# EAGLE schematic Resistor_Resistor (EAGLE 8.3.0), part 11 of 43
## Parts (continued)
R14498  10K  RESISTOR_0201  [0201]
R14499  10K  RESISTOR_0201  [0201]
R14500  10K  RESISTOR_0201  [0201]
R14501  10K  RESISTOR_0201  [0201]
R14502  10K  RESISTOR_0201  [0201]
R14503  10K  RESISTOR_0201  [0201]
R14504  10K  RESISTOR_0201  [0201]
R14505  10K  RESISTOR_0201  [0201]
R14506  10K  RESISTOR_0201  [0201]
R14507  10K  RESISTOR_0201  [0201]
R14508  10K  RESISTOR_0201  [0201]
R14509  10K  RESISTOR_0201  [0201]
R14510  10K  RESISTOR_0201  [0201]
R14511  10K  RESISTOR_0201  [0201]
R14512  10K  RESISTOR_0201  [0201]
R14513  10K  RESISTOR_0201  [0201]
R14514  10K  RESISTOR_0201  [0201]
R14515  10K  RESISTOR_0201  [0201]
R14516  10K  RESISTOR_0201  [0201]
R14517  10K  RESISTOR_0201  [0201]
R14518  10K  RESISTOR_0201  [0201]
R14519  10K  RESISTOR_0201  [0201]
R14520  10K  RESISTOR_0201  [0201]
R14521  10K  RESISTOR_0201  [0201]
R14522  10K  RESISTOR_0201  [0201]
R14523  10K  RESISTOR_0201  [0201]
R14524  10K  RESISTOR_0201  [0201]
R14525  10K  RESISTOR_0201  [0201]
R14526  10K  RESISTOR_0201  [0201]
R14527  10K  RESISTOR_0201  [0201]
R14528  10K  RESISTOR_0201  [0201]
R14529  10K  RESISTOR_0201  [0201]
R14530  10K  RESISTOR_0201  [0201]
R14531  10K  RESISTOR_0201  [0201]
R14532  10K  RESISTOR_0201  [0201]
R14533  10K  RESISTOR_0201  [0201]
R14534  10K  RESISTOR_0201  [0201]
R14535  10K  RESISTOR_0201  [0201]
R14536  10K  RESISTOR_0201  [0201]
R14537  10K  RESISTOR_0201  [0201]
R14538  10K  RESISTOR_0201  [0201]
R14539  10K  RESISTOR_0201  [0201]
R14540  10K  RESISTOR_0201  [0201]
R14541  10K  RESISTOR_0201  [0201]
R14542  10K  RESISTOR_0201  [0201]
R14543  10K  RESISTOR_0201  [0201]
R14544  10K  RESISTOR_0201  [0201]
R14545  10K  RESISTOR_0201  [0201]
R14546  10K  RESISTOR_0201  [0201]
R14547  10K  RESISTOR_0201  [0201]
R14548  10K  RESISTOR_0201  [0201]
R14549  10K  RESISTOR_0201  [0201]
R14550  10K  RESISTOR_0201  [0201]
R14551  10K  RESISTOR_0201  [0201]
R14552  10K  RESISTOR_0201  [0201]
R14553  10K  RESISTOR_0201  [0201]
R14554  10K  RESISTOR_0201  [0201]
R14555  10K  RESISTOR_0201  [0201]
R14556  10K  RESISTOR_0201  [0201]
R14557  10K  RESISTOR_0201  [0201]
R14558  10K  RESISTOR_0201  [0201]
R14559  10K  RESISTOR_0201  [0201]
R14560  10K  RESISTOR_0201  [0201]
R14561  10K  RESISTOR_0201  [0201]
R14562  10K  RESISTOR_0201  [0201]
R14563  10K  RESISTOR_0201  [0201]
R14564  10K  RESISTOR_0201  [0201]
R14565  10K  RESISTOR_0201  [0201]
R14566  10K  RESISTOR_0201  [0201]
R14567  10K  RESISTOR_0201  [0201]
R14568  10K  RESISTOR_0201  [0201]
R14569  10K  RESISTOR_0201  [0201]
R14570  10K  RESISTOR_0201  [0201]
R14571  10K  RESISTOR_0201  [0201]
R14572  10K  RESISTOR_0201  [0201]
R14573  10K  RESISTOR_0201  [0201]
R14574  10K  RESISTOR_0201  [0201]
R14575  10K  RESISTOR_0201  [0201]
R14576  10K  RESISTOR_0201  [0201]
R14577  10K  RESISTOR_0201  [0201]
R14578  10K  RESISTOR_0201  [0201]
R14579  10K  RESISTOR_0201  [0201]
R14580  10K  RESISTOR_0201  [0201]
R14581  10K  RESISTOR_0201  [0201]
R14582  10K  RESISTOR_0201  [0201]
R14583  10K  RESISTOR_0201  [0201]
R14584  10K  RESISTOR_0201  [0201]
R14585  10K  RESISTOR_0201  [0201]
R14586  10K  RESISTOR_0201  [0201]
R14587  10K  RESISTOR_0201  [0201]
R14588  10K  RESISTOR_0201  [0201]
R14589  10K  RESISTOR_0201  [0201]
R14590  10K  RESISTOR_0201  [0201]
R14591  10K  RESISTOR_0201  [0201]
R14592  10K  RESISTOR_0201  [0201]
R14593  10K  RESISTOR_0201  [0201]
R14594  10K  RESISTOR_0201  [0201]
R14595  10K  RESISTOR_0201  [0201]
R14596  10K  RESISTOR_0201  [0201]
R14597  10K  RESISTOR_0201  [0201]
R14598  10K  RESISTOR_0201  [0201]
R14599  10K  RESISTOR_0201  [0201]
R14600  10K  RESISTOR_0201  [0201]
R14601  10K  RESISTOR_0201  [0201]
R14602  10K  RESISTOR_0201  [0201]
R14603  10K  RESISTOR_0201  [0201]
R14604  10K  RESISTOR_0201  [0201]
R14605  10K  RESISTOR_0201  [0201]
R14606  10K  RESISTOR_0201  [0201]
R14607  10K  RESISTOR_0201  [0201]
R14608  10K  RESISTOR_0201  [0201]
R14609  10K  RESISTOR_0201  [0201]
R14610  10K  RESISTOR_0201  [0201]
R14611  10K  RESISTOR_0201  [0201]
R14612  10K  RESISTOR_0201  [0201]
R14613  10K  RESISTOR_0201  [0201]
R14614  10K  RESISTOR_0201  [0201]
R14615  10K  RESISTOR_0201  [0201]
R14616  10K  RESISTOR_0201  [0201]
R14617  10K  RESISTOR_0201  [0201]
R14618  10K  RESISTOR_0201  [0201]
R14619  10K  RESISTOR_0201  [0201]
R14620  10K  RESISTOR_0201  [0201]
R14621  10K  RESISTOR_0201  [0201]
R14622  10K  RESISTOR_0201  [0201]
R14623  10K  RESISTOR_0201  [0201]
R14624  10K  RESISTOR_0201  [0201]
R14625  10K  RESISTOR_0201  [0201]
R14626  10K  RESISTOR_0201  [0201]
R14627  10K  RESISTOR_0201  [0201]
R14628  10K  RESISTOR_0201  [0201]
R14629  10K  RESISTOR_0201  [0201]
R14630  10K  RESISTOR_0201  [0201]
R14631  10K  RESISTOR_0201  [0201]
R14632  10K  RESISTOR_0201  [0201]
R14633  10K  RESISTOR_0201  [0201]
R14634  10K  RESISTOR_0201  [0201]
R14635  10K  RESISTOR_0201  [0201]
R14636  10K  RESISTOR_0201  [0201]
R14637  10K  RESISTOR_0201  [0201]
R14638  10K  RESISTOR_0201  [0201]
R14639  10K  RESISTOR_0201  [0201]
R14640  10K  RESISTOR_0201  [0201]
R14641  10K  RESISTOR_0201  [0201]
R14642  10K  RESISTOR_0201  [0201]
R14643  10K  RESISTOR_0201  [0201]
R14644  10K  RESISTOR_0201  [0201]
R14645  10K  RESISTOR_0201  [0201]
R14646  10K  RESISTOR_0201  [0201]
R14647  10K  RESISTOR_0201  [0201]
R14648  10K  RESISTOR_0201  [0201]
R14649  10K  RESISTOR_0201  [0201]
R14650  10K  RESISTOR_0201  [0201]
R14651  10K  RESISTOR_0201  [0201]
R14652  10K  RESISTOR_0201  [0201]
R14653  10K  RESISTOR_0201  [0201]
R14654  10K  RESISTOR_0201  [0201]
R14655  10K  RESISTOR_0201  [0201]
R14656  10K  RESISTOR_0201  [0201]
R14657  10K  RESISTOR_0201  [0201]
R14658  10K  RESISTOR_0201  [0201]
R14659  10K  RESISTOR_0201  [0201]
R14660  10K  RESISTOR_0201  [0201]
R14661  10K  RESISTOR_0201  [0201]
R14662  10K  RESISTOR_0201  [0201]
R14663  10K  RESISTOR_0201  [0201]
R14664  10K  RESISTOR_0201  [0201]
R14665  10K  RESISTOR_0201  [0201]
R14666  10K  RESISTOR_0201  [0201]
R14667  10K  RESISTOR_0201  [0201]
R14668  10K  RESISTOR_0201  [0201]
R14669  10K  RESISTOR_0201  [0201]
R14670  10K  RESISTOR_0201  [0201]
R14671  10K  RESISTOR_0201  [0201]
R14672  10K  RESISTOR_0201  [0201]
R14673  10K  RESISTOR_0201  [0201]
R14674  10K  RESISTOR_0201  [0201]
R14675  10K  RESISTOR_0201  [0201]
R14676  10K  RESISTOR_0201  [0201]
R14677  10K  RESISTOR_0201  [0201]
R14678  10K  RESISTOR_0201  [0201]
R14679  10K  RESISTOR_0201  [0201]
R14680  10K  RESISTOR_0201  [0201]
R14681  10K  RESISTOR_0201  [0201]
R14682  10K  RESISTOR_0201  [0201]
R14683  10K  RESISTOR_0201  [0201]
R14684  10K  RESISTOR_0201  [0201]
R14685  10K  RESISTOR_0201  [0201]
R14686  10K  RESISTOR_0201  [0201]
R14687  10K  RESISTOR_0201  [0201]
R14688  10K  RESISTOR_0201  [0201]
R14689  10K  RESISTOR_0201  [0201]
R14690  10K  RESISTOR_0201  [0201]
R14691  10K  RESISTOR_0201  [0201]
R14692  10K  RESISTOR_0201  [0201]
R14693  10K  RESISTOR_0201  [0201]
R14694  10K  RESISTOR_0201  [0201]
R14695  10K  RESISTOR_0201  [0201]
R14696  10K  RESISTOR_0201  [0201]
R14697  10K  RESISTOR_0201  [0201]
R14698  10K  RESISTOR_0201  [0201]
R14699  10K  RESISTOR_0201  [0201]
R14700  10K  RESISTOR_0201  [0201]
R14701  10K  RESISTOR_0201  [0201]
R14702  10K  RESISTOR_0201  [0201]
R14703  10K  RESISTOR_0201  [0201]
R14704  10K  RESISTOR_0201  [0201]
R14705  10K  RESISTOR_0201  [0201]
R14706  10K  RESISTOR_0201  [0201]
R14707  10K  RESISTOR_0201  [0201]
R14708  10K  RESISTOR_0201  [0201]
R14709  10K  RESISTOR_0201  [0201]
R14710  10K  RESISTOR_0201  [0201]
R14711  10K  RESISTOR_0201  [0201]
R14712  10K  RESISTOR_0201  [0201]
R14713  10K  RESISTOR_0201  [0201]
R14714  10K  RESISTOR_0201  [0201]
R14715  10K  RESISTOR_0201  [0201]
R14716  10K  RESISTOR_0201  [0201]
R14717  10K  RESISTOR_0201  [0201]
R14718  10K  RESISTOR_0201  [0201]
R14719  10K  RESISTOR_0201  [0201]
R14720  10K  RESISTOR_0201  [0201]
R14721  10K  RESISTOR_0201  [0201]
R14722  10K  RESISTOR_0201  [0201]
R14723  10K  RESISTOR_0201  [0201]
R14724  10K  RESISTOR_0201  [0201]
R14725  10K  RESISTOR_0201  [0201]
R14726  10K  RESISTOR_0201  [0201]
R14727  10K  RESISTOR_0201  [0201]
R14728  10K  RESISTOR_0201  [0201]
R14729  10K  RESISTOR_0201  [0201]
R14730  10K  RESISTOR_0201  [0201]
R14731  10K  RESISTOR_0201  [0201]
R14732  10K  RESISTOR_0201  [0201]
R14733  10K  RESISTOR_0201  [0201]
R14734  10K  RESISTOR_0201  [0201]
R14735  10K  RESISTOR_0201  [0201]
R14736  10K  RESISTOR_0201  [0201]
R14737  10K  RESISTOR_0201  [0201]
R14738  10K  RESISTOR_0201  [0201]
R14739  10K  RESISTOR_0201  [0201]
R14740  10K  RESISTOR_0201  [0201]
R14741  10K  RESISTOR_0201  [0201]
R14742  10K  RESISTOR_0201  [0201]
R14743  10K  RESISTOR_0201  [0201]
R14744  10K  RESISTOR_0201  [0201]
R14745  10K  RESISTOR_0201  [0201]
R14746  10K  RESISTOR_0201  [0201]
R14747  10K  RESISTOR_0201  [0201]
R14748  10K  RESISTOR_0201  [0201]
R14749  10K  RESISTOR_0201  [0201]
R14750  10K  RESISTOR_0201  [0201]
R14751  10K  RESISTOR_0201  [0201]
R14752  10K  RESISTOR_0201  [0201]
R14753  10K  RESISTOR_0201  [0201]
R14754  10K  RESISTOR_0201  [0201]
R14755  10K  RESISTOR_0201  [0201]
R14756  10K  RESISTOR_0201  [0201]
R14757  10K  RESISTOR_0201  [0201]
R14758  10K  RESISTOR_0201  [0201]
R14759  10K  RESISTOR_0201  [0201]
R14760  10K  RESISTOR_0201  [0201]
R14761  10K  RESISTOR_0201  [0201]
R14762  10K  RESISTOR_0201  [0201]
R14763  10K  RESISTOR_0201  [0201]
R14764  10K  RESISTOR_0201  [0201]
R14765  10K  RESISTOR_0201  [0201]
R14766  10K  RESISTOR_0201  [0201]
R14767  10K  RESISTOR_0201  [0201]
R14768  10K  RESISTOR_0201  [0201]
R14769  10K  RESISTOR_0201  [0201]
R14770  10K  RESISTOR_0201  [0201]
R14771  10K  RESISTOR_0201  [0201]
R14772  10K  RESISTOR_0201  [0201]
R14773  10K  RESISTOR_0201  [0201]
R14774  10K  RESISTOR_0201  [0201]
R14775  10K  RESISTOR_0201  [0201]
R14776  10K  RESISTOR_0201  [0201]
R14777  10K  RESISTOR_0201  [0201]
R14778  10K  RESISTOR_0201  [0201]
R14779  10K  RESISTOR_0201  [0201]
R14780  10K  RESISTOR_0201  [0201]
R14781  10K  RESISTOR_0201  [0201]
R14782  10K  RESISTOR_0201  [0201]
R14783  10K  RESISTOR_0201  [0201]
R14784  10K  RESISTOR_0201  [0201]
R14785  10K  RESISTOR_0201  [0201]
R14786  10K  RESISTOR_0201  [0201]
R14787  10K  RESISTOR_0201  [0201]
R14788  10K  RESISTOR_0201  [0201]
R14789  10K  RESISTOR_0201  [0201]
R14790  10K  RESISTOR_0201  [0201]
R14791  10K  RESISTOR_0201  [0201]
R14792  10K  RESISTOR_0201  [0201]
R14793  10K  RESISTOR_0201  [0201]
R14794  10K  RESISTOR_0201  [0201]
R14795  10K  RESISTOR_0201  [0201]
R14796  10K  RESISTOR_0201  [0201]
R14797  10K  RESISTOR_0201  [0201]
R14798  10K  RESISTOR_0201  [0201]
R14799  10K  RESISTOR_0201  [0201]
R14800  10K  RESISTOR_0201  [0201]
R14801  10K  RESISTOR_0201  [0201]
R14802  10K  RESISTOR_0201  [0201]
R14803  10K  RESISTOR_0201  [0201]
R14804  10K  RESISTOR_0201  [0201]
R14805  10K  RESISTOR_0201  [0201]
R14806  10K  RESISTOR_0201  [0201]
R14807  10K  RESISTOR_0201  [0201]
R14808  10K  RESISTOR_0201  [0201]
R14809  10K  RESISTOR_0201  [0201]
R14810  10K  RESISTOR_0201  [0201]
R14811  10K  RESISTOR_0201  [0201]
R14812  10K  RESISTOR_0201  [0201]
R14813  10K  RESISTOR_0201  [0201]
R14814  10K  RESISTOR_0201  [0201]
R14815  10K  RESISTOR_0201  [0201]
R14816  10K  RESISTOR_0201  [0201]
R14817  10K  RESISTOR_0201  [0201]
R14818  10K  RESISTOR_0201  [0201]
R14819  10K  RESISTOR_0201  [0201]
R14820  10K  RESISTOR_0201  [0201]
R14821  10K  RESISTOR_0201  [0201]
R14822  10K  RESISTOR_0201  [0201]
R14823  10K  RESISTOR_0201  [0201]
R14824  10K  RESISTOR_0201  [0201]
R14825  10K  RESISTOR_0201  [0201]
R14826  10K  RESISTOR_0201  [0201]
R14827  10K  RESISTOR_0201  [0201]
R14828  10K  RESISTOR_0201  [0201]
R14829  10K  RESISTOR_0201  [0201]
R14830  10K  RESISTOR_0201  [0201]
R14831  10K  RESISTOR_0201  [0201]
R14832  10K  RESISTOR_0201  [0201]
R14833  10K  RESISTOR_0201  [0201]
R14834  10K  RESISTOR_0201  [0201]
R14835  10K  RESISTOR_0201  [0201]
R14836  10K  RESISTOR_0201  [0201]
R14837  10K  RESISTOR_0201  [0201]
R14838  10K  RESISTOR_0201  [0201]
R14839  10K  RESISTOR_0201  [0201]
R14840  10K  RESISTOR_0201  [0201]
R14841  10K  RESISTOR_0201  [0201]
R14842  10K  RESISTOR_0201  [0201]
R14843  10K  RESISTOR_0201  [0201]
R14844  10K  RESISTOR_0201  [0201]
R14845  10K  RESISTOR_0201  [0201]
R14846  10K  RESISTOR_0201  [0201]
R14847  10K  RESISTOR_0201  [0201]
R14848  10K  RESISTOR_0201  [0201]
R14849  10K  RESISTOR_0201  [0201]
R14850  10K  RESISTOR_0201  [0201]
R14851  10K  RESISTOR_0201  [0201]
R14852  10K  RESISTOR_0201  [0201]
R14853  10K  RESISTOR_0201  [0201]
R14854  10K  RESISTOR_0201  [0201]
R14855  10K  RESISTOR_0201  [0201]
R14856  10K  RESISTOR_0201  [0201]
R14857  10K  RESISTOR_0201  [0201]
R14858  10K  RESISTOR_0201  [0201]
R14859  10K  RESISTOR_0201  [0201]
R14860  10K  RESISTOR_0201  [0201]
R14861  10K  RESISTOR_0201  [0201]
R14862  10K  RESISTOR_0201  [0201]
R14863  10K  RESISTOR_0201  [0201]
R14864  10K  RESISTOR_0201  [0201]
R14865  10K  RESISTOR_0201  [0201]
R14866  10K  RESISTOR_0201  [0201]
R14867  10K  RESISTOR_0201  [0201]
R14868  10K  RESISTOR_0201  [0201]
R14869  10K  RESISTOR_0201  [0201]
R14870  10K  RESISTOR_0201  [0201]
R14871  10K  RESISTOR_0201  [0201]
R14872  10K  RESISTOR_0201  [0201]
R14873  10K  RESISTOR_0201  [0201]
R14874  10K  RESISTOR_0201  [0201]
R14875  10K  RESISTOR_0201  [0201]
R14876  10K  RESISTOR_0201  [0201]
R14877  10K  RESISTOR_0201  [0201]
R14878  10K  RESISTOR_0201  [0201]
R14879  10K  RESISTOR_0201  [0201]
R14880  10K  RESISTOR_0201  [0201]
R14881  10K  RESISTOR_0201  [0201]
R14882  10K  RESISTOR_0201  [0201]
R14883  10K  RESISTOR_0201  [0201]
R14884  10K  RESISTOR_0201  [0201]
R14885  10K  RESISTOR_0201  [0201]
R14886  10K  RESISTOR_0201  [0201]
R14887  10K  RESISTOR_0201  [0201]
R14888  10K  RESISTOR_0201  [0201]
R14889  10K  RESISTOR_0201  [0201]
R14890  10K  RESISTOR_0201  [0201]
R14891  10K  RESISTOR_0201  [0201]
R14892  10K  RESISTOR_0201  [0201]
R14893  10K  RESISTOR_0201  [0201]
R14894  10K  RESISTOR_0201  [0201]
R14895  10K  RESISTOR_0201  [0201]
R14896  10K  RESISTOR_0201  [0201]
R14897  10K  RESISTOR_0201  [0201]
R14898  10K  RESISTOR_0201  [0201]
R14899  10K  RESISTOR_0201  [0201]
R14900  10K  RESISTOR_0201  [0201]
R14901  10K  RESISTOR_0201  [0201]
R14902  10K  RESISTOR_0201  [0201]
R14903  10K  RESISTOR_0201  [0201]
R14904  10K  RESISTOR_0201  [0201]
R14905  10K  RESISTOR_0201  [0201]
R14906  10K  RESISTOR_0201  [0201]
R14907  10K  RESISTOR_0201  [0201]
R14908  10K  RESISTOR_0201  [0201]
R14909  10K  RESISTOR_0201  [0201]
R14910  10K  RESISTOR_0201  [0201]
R14911  10K  RESISTOR_0201  [0201]
R14912  10K  RESISTOR_0201  [0201]
R14913  10K  RESISTOR_0201  [0201]
R14914  10K  RESISTOR_0201  [0201]
R14915  10K  RESISTOR_0201  [0201]
R14916  10K  RESISTOR_0201  [0201]
R14917  10K  RESISTOR_0201  [0201]
R14918  10K  RESISTOR_0201  [0201]
R14919  10K  RESISTOR_0201  [0201]
R14920  10K  RESISTOR_0201  [0201]
R14921  10K  RESISTOR_0201  [0201]
R14922  10K  RESISTOR_0201  [0201]
R14923  10K  RESISTOR_0201  [0201]
R14924  10K  RESISTOR_0201  [0201]
R14925  10K  RESISTOR_0201  [0201]
R14926  10K  RESISTOR_0201  [0201]
R14927  10K  RESISTOR_0201  [0201]
R14928  10K  RESISTOR_0201  [0201]
R14929  10K  RESISTOR_0201  [0201]
R14930  10K  RESISTOR_0201  [0201]
R14931  10K  RESISTOR_0201  [0201]
R14932  10K  RESISTOR_0201  [0201]
R14933  10K  RESISTOR_0201  [0201]
R14934  10K  RESISTOR_0201  [0201]
R14935  10K  RESISTOR_0201  [0201]
R14936  10K  RESISTOR_0201  [0201]
R14937  10K  RESISTOR_0201  [0201]
R14938  10K  RESISTOR_0201  [0201]
R14939  10K  RESISTOR_0201  [0201]
R14940  10K  RESISTOR_0201  [0201]
R14941  10K  RESISTOR_0201  [0201]
R14942  10K  RESISTOR_0201  [0201]
R14943  10K  RESISTOR_0201  [0201]
R14944  10K  RESISTOR_0201  [0201]
R14945  10K  RESISTOR_0201  [0201]
R14946  10K  RESISTOR_0201  [0201]
R14947  10K  RESISTOR_0201  [0201]
R14948  10K  RESISTOR_0201  [0201]
R14949  10K  RESISTOR_0201  [0201]
R14950  10K  RESISTOR_0201  [0201]
R14951  10K  RESISTOR_0201  [0201]
R14952  10K  RESISTOR_0201  [0201]
R14953  10K  RESISTOR_0201  [0201]
R14954  10K  RESISTOR_0201  [0201]
R14955  10K  RESISTOR_0201  [0201]
R14956  10K  RESISTOR_0201  [0201]
R14957  10K  RESISTOR_0201  [0201]
R14958  10K  RESISTOR_0201  [0201]
R14959  10K  RESISTOR_0201  [0201]
R14960  10K  RESISTOR_0201  [0201]
R14961  10K  RESISTOR_0201  [0201]
R14962  10K  RESISTOR_0201  [0201]
R14963  10K  RESISTOR_0201  [0201]
R14964  10K  RESISTOR_0201  [0201]
R14965  10K  RESISTOR_0201  [0201]
R14966  10K  RESISTOR_0201  [0201]
R14967  10K  RESISTOR_0201  [0201]
R14968  10K  RESISTOR_0201  [0201]
R14969  10K  RESISTOR_0201  [0201]
R14970  10K  RESISTOR_0201  [0201]
R14971  10K  RESISTOR_0201  [0201]
R14972  10K  RESISTOR_0201  [0201]
R14973  10K  RESISTOR_0201  [0201]
R14974  10K  RESISTOR_0201  [0201]
R14975  10K  RESISTOR_0201  [0201]
R14976  10K  RESISTOR_0201  [0201]
R14977  10K  RESISTOR_0201  [0201]
R14978  10K  RESISTOR_0201  [0201]
R14979  10K  RESISTOR_0201  [0201]
R14980  10K  RESISTOR_0201  [0201]
R14981  10K  RESISTOR_0201  [0201]
R14982  10K  RESISTOR_0201  [0201]
R14983  10K  RESISTOR_0201  [0201]
R14984  10K  RESISTOR_0201  [0201]
R14985  10K  RESISTOR_0201  [0201]
R14986  10K  RESISTOR_0201  [0201]
R14987  10K  RESISTOR_0201  [0201]
R14988  10K  RESISTOR_0201  [0201]
R14989  10K  RESISTOR_0201  [0201]
R14990  10K  RESISTOR_0201  [0201]
R14991  10K  RESISTOR_0201  [0201]
R14992  10K  RESISTOR_0201  [0201]
R14993  10K  RESISTOR_0201  [0201]
R14994  10K  RESISTOR_0201  [0201]
R14995  10K  RESISTOR_0201  [0201]
R14996  10K  RESISTOR_0201  [0201]
R14997  10K  RESISTOR_0201  [0201]
R14998  10K  RESISTOR_0201  [0201]
R14999  10K  RESISTOR_0201  [0201]
R15000  10K  RESISTOR_0201  [0201]
R15001  10K  RESISTOR_0201  [0201]
R15002  10K  RESISTOR_0201  [0201]
R15003  10K  RESISTOR_0201  [0201]
R15004  10K  RESISTOR_0201  [0201]
R15005  10K  RESISTOR_0201  [0201]
R15006  10K  RESISTOR_0201  [0201]
R15007  10K  RESISTOR_0201  [0201]
R15008  10K  RESISTOR_0201  [0201]
R15009  10K  RESISTOR_0201  [0201]
R15010  10K  RESISTOR_0201  [0201]
R15011  10K  RESISTOR_0201  [0201]
R15012  10K  RESISTOR_0201  [0201]
R15013  10K  RESISTOR_0201  [0201]
R15014  10K  RESISTOR_0201  [0201]
R15015  10K  RESISTOR_0201  [0201]
R15016  10K  RESISTOR_0201  [0201]
R15017  10K  RESISTOR_0201  [0201]
R15018  10K  RESISTOR_0201  [0201]
R15019  10K  RESISTOR_0201  [0201]
R15020  10K  RESISTOR_0201  [0201]
R15021  10K  RESISTOR_0201  [0201]
R15022  10K  RESISTOR_0201  [0201]
R15023  10K  RESISTOR_0201  [0201]
R15024  10K  RESISTOR_0201  [0201]
R15025  10K  RESISTOR_0201  [0201]
R15026  10K  RESISTOR_0201  [0201]
R15027  10K  RESISTOR_0201  [0201]
R15028  10K  RESISTOR_0201  [0201]
R15029  10K  RESISTOR_0201  [0201]
R15030  10K  RESISTOR_0201  [0201]
R15031  10K  RESISTOR_0201  [0201]
R15032  10K  RESISTOR_0201  [0201]
R15033  10K  RESISTOR_0201  [0201]
R15034  10K  RESISTOR_0201  [0201]
R15035  10K  RESISTOR_0201  [0201]
R15036  10K  RESISTOR_0201  [0201]
R15037  10K  RESISTOR_0201  [0201]
R15038  10K  RESISTOR_0201  [0201]
R15039  10K  RESISTOR_0201  [0201]
R15040  10K  RESISTOR_0201  [0201]
R15041  10K  RESISTOR_0201  [0201]
R15042  10K  RESISTOR_0201  [0201]
R15043  10K  RESISTOR_0201  [0201]
R15044  10K  RESISTOR_0201  [0201]
R15045  10K  RESISTOR_0201  [0201]
R15046  10K  RESISTOR_0201  [0201]
R15047  10K  RESISTOR_0201  [0201]
R15048  10K  RESISTOR_0201  [0201]
R15049  10K  RESISTOR_0201  [0201]
R15050  10K  RESISTOR_0201  [0201]
R15051  10K  RESISTOR_0201  [0201]
R15052  10K  RESISTOR_0201  [0201]
R15053  10K  RESISTOR_0201  [0201]
R15054  10K  RESISTOR_0201  [0201]
R15055  10K  RESISTOR_0201  [0201]
R15056  10K  RESISTOR_0201  [0201]
R15057  10K  RESISTOR_0201  [0201]
R15058  10K  RESISTOR_0201  [0201]
R15059  10K  RESISTOR_0201  [0201]
R15060  10K  RESISTOR_0201  [0201]
R15061  10K  RESISTOR_0201  [0201]
R15062  10K  RESISTOR_0201  [0201]
R15063  10K  RESISTOR_0201  [0201]
R15064  10K  RESISTOR_0201  [0201]
R15065  10K  RESISTOR_0201  [0201]
R15066  10K  RESISTOR_0201  [0201]
R15067  10K  RESISTOR_0201  [0201]
R15068  10K  RESISTOR_0201  [0201]
R15069  10K  RESISTOR_0201  [0201]
R15070  10K  RESISTOR_0201  [0201]
R15071  10K  RESISTOR_0201  [0201]
R15072  10K  RESISTOR_0201  [0201]
R15073  10K  RESISTOR_0201  [0201]
R15074  10K  RESISTOR_0201  [0201]
R15075  10K  RESISTOR_0201  [0201]
R15076  10K  RESISTOR_0201  [0201]
R15077  10K  RESISTOR_0201  [0201]
R15078  10K  RESISTOR_0201  [0201]
R15079  10K  RESISTOR_0201  [0201]
R15080  10K  RESISTOR_0201  [0201]
R15081  10K  RESISTOR_0201  [0201]
R15082  10K  RESISTOR_0201  [0201]
R15083  10K  RESISTOR_0201  [0201]
R15084  10K  RESISTOR_0201  [0201]
R15085  10K  RESISTOR_0201  [0201]
R15086  10K  RESISTOR_0201  [0201]
R15087  10K  RESISTOR_0201  [0201]
R15088  10K  RESISTOR_0201  [0201]
R15089  10K  RESISTOR_0201  [0201]
R15090  10K  RESISTOR_0201  [0201]
R15091  10K  RESISTOR_0201  [0201]
R15092  10K  RESISTOR_0201  [0201]
R15093  10K  RESISTOR_0201  [0201]
R15094  10K  RESISTOR_0201  [0201]
R15095  10K  RESISTOR_0201  [0201]
R15096  10K  RESISTOR_0201  [0201]
R15097  10K  RESISTOR_0201  [0201]
R15098  10K  RESISTOR_0201  [0201]
R15099  10K  RESISTOR_0201  [0201]
R15100  10K  RESISTOR_0201  [0201]
R15101  10K  RESISTOR_0201  [0201]
R15102  10K  RESISTOR_0201  [0201]
R15103  10K  RESISTOR_0201  [0201]
R15104  10K  RESISTOR_0201  [0201]
R15105  10K  RESISTOR_0201  [0201]
R15106  10K  RESISTOR_0201  [0201]
R15107  10K  RESISTOR_0201  [0201]
R15108  10K  RESISTOR_0201  [0201]
R15109  10K  RESISTOR_0201  [0201]
R15110  10K  RESISTOR_0201  [0201]
R15111  10K  RESISTOR_0201  [0201]
R15112  10K  RESISTOR_0201  [0201]
R15113  10K  RESISTOR_0201  [0201]
R15114  10K  RESISTOR_0201  [0201]
R15115  10K  RESISTOR_0201  [0201]
R15116  10K  RESISTOR_0201  [0201]
R15117  10K  RESISTOR_0201  [0201]
R15118  10K  RESISTOR_0201  [0201]
R15119  10K  RESISTOR_0201  [0201]
R15120  10K  RESISTOR_0201  [0201]
R15121  10K  RESISTOR_0201  [0201]
R15122  10K  RESISTOR_0201  [0201]
R15123  10K  RESISTOR_0201  [0201]
R15124  10K  RESISTOR_0201  [0201]
R15125  10K  RESISTOR_0201  [0201]
R15126  10K  RESISTOR_0201  [0201]
R15127  10K  RESISTOR_0201  [0201]
R15128  10K  RESISTOR_0201  [0201]
R15129  10K  RESISTOR_0201  [0201]
R15130  10K  RESISTOR_0201  [0201]
R15131  10K  RESISTOR_0201  [0201]
R15132  10K  RESISTOR_0201  [0201]
R15133  10K  RESISTOR_0201  [0201]
R15134  10K  RESISTOR_0201  [0201]
R15135  10K  RESISTOR_0201  [0201]
R15136  10K  RESISTOR_0201  [0201]
R15137  10K  RESISTOR_0201  [0201]
R15138  10K  RESISTOR_0201  [0201]
R15139  10K  RESISTOR_0201  [0201]
R15140  10K  RESISTOR_0201  [0201]
R15141  10K  RESISTOR_0201  [0201]
R15142  10K  RESISTOR_0201  [0201]
R15143  10K  RESISTOR_0201  [0201]
R15144  10K  RESISTOR_0201  [0201]
R15145  10K  RESISTOR_0201  [0201]
R15146  10K  RESISTOR_0201  [0201]
R15147  10K  RESISTOR_0201  [0201]
R15148  10K  RESISTOR_0201  [0201]
R15149  10K  RESISTOR_0201  [0201]
R15150  10K  RESISTOR_0201  [0201]
R15151  10K  RESISTOR_0201  [0201]
R15152  10K  RESISTOR_0201  [0201]
R15153  10K  RESISTOR_0201  [0201]
R15154  10K  RESISTOR_0201  [0201]
R15155  10K  RESISTOR_0201  [0201]
R15156  10K  RESISTOR_0201  [0201]
R15157  10K  RESISTOR_0201  [0201]
R15158  10K  RESISTOR_0201  [0201]
R15159  10K  RESISTOR_0201  [0201]
R15160  10K  RESISTOR_0201  [0201]
R15161  10K  RESISTOR_0201  [0201]
R15162  10K  RESISTOR_0201  [0201]
R15163  10K  RESISTOR_0201  [0201]
R15164  10K  RESISTOR_0201  [0201]
R15165  10K  RESISTOR_0201  [0201]
R15166  10K  RESISTOR_0201  [0201]
R15167  10K  RESISTOR_0201  [0201]
R15168  10K  RESISTOR_0201  [0201]
R15169  10K  RESISTOR_0201  [0201]
R15170  10K  RESISTOR_0201  [0201]
R15171  10K  RESISTOR_0201  [0201]
R15172  10K  RESISTOR_0201  [0201]
R15173  10K  RESISTOR_0201  [0201]
R15174  10K  RESISTOR_0201  [0201]
R15175  10K  RESISTOR_0201  [0201]
R15176  10K  RESISTOR_0201  [0201]
R15177  10K  RESISTOR_0201  [0201]
R15178  10K  RESISTOR_0201  [0201]
R15179  10K  RESISTOR_0201  [0201]
R15180  10K  RESISTOR_0201  [0201]
R15181  10K  RESISTOR_0201  [0201]
R15182  10K  RESISTOR_0201  [0201]
R15183  10K  RESISTOR_0201  [0201]
R15184  10K  RESISTOR_0201  [0201]
R15185  10K  RESISTOR_0201  [0201]
R15186  10K  RESISTOR_0201  [0201]
R15187  10K  RESISTOR_0201  [0201]
R15188  10K  RESISTOR_0201  [0201]
R15189  10K  RESISTOR_0201  [0201]
R15190  10K  RESISTOR_0201  [0201]
R15191  10K  RESISTOR_0201  [0201]
R15192  10K  RESISTOR_0201  [0201]
R15193  10K  RESISTOR_0201  [0201]
R15194  10K  RESISTOR_0201  [0201]
R15195  10K  RESISTOR_0201  [0201]
R15196  10K  RESISTOR_0201  [0201]
R15197  10K  RESISTOR_0201  [0201]
R15198  10K  RESISTOR_0201  [0201]
R15199  10K  RESISTOR_0201  [0201]
R15200  10K  RESISTOR_0201  [0201]
R15201  10K  RESISTOR_0201  [0201]
R15202  10K  RESISTOR_0201  [0201]
R15203  10K  RESISTOR_0201  [0201]
R15204  10K  RESISTOR_0201  [0201]
R15205  10K  RESISTOR_0201  [0201]
R15206  10K  RESISTOR_0201  [0201]
R15207  10K  RESISTOR_0201  [0201]
R15208  10K  RESISTOR_0201  [0201]
R15209  10K  RESISTOR_0201  [0201]
R15210  10K  RESISTOR_0201  [0201]
R15211  10K  RESISTOR_0201  [0201]
R15212  10K  RESISTOR_0201  [0201]
R15213  10K  RESISTOR_0201  [0201]
R15214  10K  RESISTOR_0201  [0201]
R15215  10K  RESISTOR_0201  [0201]
R15216  10K  RESISTOR_0201  [0201]
R15217  10K  RESISTOR_0201  [0201]
R15218  10K  RESISTOR_0201  [0201]
R15219  10K  RESISTOR_0201  [0201]
R15220  10K  RESISTOR_0201  [0201]
R15221  10K  RESISTOR_0201  [0201]
R15222  10K  RESISTOR_0201  [0201]
R15223  10K  RESISTOR_0201  [0201]
R15224  10K  RESISTOR_0201  [0201]
R15225  10K  RESISTOR_0201  [0201]
R15226  10K  RESISTOR_0201  [0201]
R15227  10K  RESISTOR_0201  [0201]
R15228  10K  RESISTOR_0201  [0201]
R15229  10K  RESISTOR_0201  [0201]
R15230  10K  RESISTOR_0201  [0201]
R15231  10K  RESISTOR_0201  [0201]
R15232  10K  RESISTOR_0201  [0201]
R15233  10K  RESISTOR_0201  [0201]
R15234  10K  RESISTOR_0201  [0201]
R15235  10K  RESISTOR_0201  [0201]
R15236  10K  RESISTOR_0201  [0201]
R15237  10K  RESISTOR_0201  [0201]
R15238  10K  RESISTOR_0201  [0201]
R15239  10K  RESISTOR_0201  [0201]
R15240  10K  RESISTOR_0201  [0201]
R15241  10K  RESISTOR_0201  [0201]
R15242  10K  RESISTOR_0201  [0201]
R15243  10K  RESISTOR_0201  [0201]
R15244  10K  RESISTOR_0201  [0201]
R15245  10K  RESISTOR_0201  [0201]
R15246  10K  RESISTOR_0201  [0201]
R15247  10K  RESISTOR_0201  [0201]
R15248  10K  RESISTOR_0201  [0201]
R15249  10K  RESISTOR_0201  [0201]
R15250  10K  RESISTOR_0201  [0201]
R15251  10K  RESISTOR_0201  [0201]
R15252  10K  RESISTOR_0201  [0201]
R15253  10K  RESISTOR_0201  [0201]
R15254  10K  RESISTOR_0201  [0201]
R15255  10K  RESISTOR_0201  [0201]
R15256  10K  RESISTOR_0201  [0201]
R15257  10K  RESISTOR_0201  [0201]
R15258  10K  RESISTOR_0201  [0201]
R15259  10K  RESISTOR_0201  [0201]
R15260  10K  RESISTOR_0201  [0201]
R15261  10K  RESISTOR_0201  [0201]
R15262  10K  RESISTOR_0201  [0201]
R15263  10K  RESISTOR_0201  [0201]
R15264  10K  RESISTOR_0201  [0201]
R15265  10K  RESISTOR_0201  [0201]
R15266  10K  RESISTOR_0201  [0201]
R15267  10K  RESISTOR_0201  [0201]
R15268  10K  RESISTOR_0201  [0201]
R15269  10K  RESISTOR_0201  [0201]
R15270  10K  RESISTOR_0201  [0201]
R15271  10K  RESISTOR_0201  [0201]
R15272  10K  RESISTOR_0201  [0201]
R15273  10K  RESISTOR_0201  [0201]
R15274  10K  RESISTOR_0201  [0201]
R15275  10K  RESISTOR_0201  [0201]
R15276  10K  RESISTOR_0201  [0201]
R15277  10K  RESISTOR_0201  [0201]
R15278  10K  RESISTOR_0201  [0201]
R15279  10K  RESISTOR_0201  [0201]
R15280  10K  RESISTOR_0201  [0201]
R15281  10K  RESISTOR_0201  [0201]
R15282  10K  RESISTOR_0201  [0201]
R15283  10K  RESISTOR_0201  [0201]
R15284  10K  RESISTOR_0201  [0201]
R15285  10K  RESISTOR_0201  [0201]
R15286  10K  RESISTOR_0201  [0201]
R15287  10K  RESISTOR_0201  [0201]
R15288  10K  RESISTOR_0201  [0201]
R15289  10K  RESISTOR_0201  [0201]
R15290  10K  RESISTOR_0201  [0201]
R15291  10K  RESISTOR_0201  [0201]
R15292  10K  RESISTOR_0201  [0201]
R15293  10K  RESISTOR_0201  [0201]
R15294  10K  RESISTOR_0201  [0201]
R15295  10K  RESISTOR_0201  [0201]
R15296  10K  RESISTOR_0201  [0201]
R15297  10K  RESISTOR_0201  [0201]
R15298  10K  RESISTOR_0201  [0201]
R15299  10K  RESISTOR_0201  [0201]
R15300  10K  RESISTOR_0201  [0201]
R15301  10K  RESISTOR_0201  [0201]
R15302  10K  RESISTOR_0201  [0201]
R15303  10K  RESISTOR_0201  [0201]
R15304  10K  RESISTOR_0201  [0201]
R15305  10K  RESISTOR_0201  [0201]
R15306  10K  RESISTOR_0201  [0201]
R15307  10K  RESISTOR_0201  [0201]
R15308  10K  RESISTOR_0201  [0201]
R15309  10K  RESISTOR_0201  [0201]
R15310  10K  RESISTOR_0201  [0201]
R15311  10K  RESISTOR_0201  [0201]
R15312  10K  RESISTOR_0201  [0201]
R15313  10K  RESISTOR_0201  [0201]
R15314  10K  RESISTOR_0201  [0201]
R15315  10K  RESISTOR_0201  [0201]
R15316  10K  RESISTOR_0201  [0201]
R15317  10K  RESISTOR_0201  [0201]
R15318  10K  RESISTOR_0201  [0201]
R15319  10K  RESISTOR_0201  [0201]
R15320  10K  RESISTOR_0201  [0201]
R15321  10K  RESISTOR_0201  [0201]
R15322  10K  RESISTOR_0201  [0201]
R15323  10K  RESISTOR_0201  [0201]
R15324  10K  RESISTOR_0201  [0201]
R15325  10K  RESISTOR_0201  [0201]
R15326  10K  RESISTOR_0201  [0201]
R15327  10K  RESISTOR_0201  [0201]
R15328  10K  RESISTOR_0201  [0201]
R15329  10K  RESISTOR_0201  [0201]
R15330  10K  RESISTOR_0201  [0201]
R15331  10K  RESISTOR_0201  [0201]
R15332  10K  RESISTOR_0201  [0201]
R15333  10K  RESISTOR_0201  [0201]
R15334  10K  RESISTOR_0201  [0201]
R15335  10K  RESISTOR_0201  [0201]
R15336  10K  RESISTOR_0201  [0201]
R15337  10K  RESISTOR_0201  [0201]
R15338  10K  RESISTOR_0201  [0201]
R15339  10K  RESISTOR_0201  [0201]
R15340  10K  RESISTOR_0201  [0201]
R15341  10K  RESISTOR_0201  [0201]
R15342  10K  RESISTOR_0201  [0201]
R15343  10K  RESISTOR_0201  [0201]
R15344  10K  RESISTOR_0201  [0201]
R15345  10K  RESISTOR_0201  [0201]
R15346  10K  RESISTOR_0201  [0201]
R15347  10K  RESISTOR_0201  [0201]
R15348  10K  RESISTOR_0201  [0201]
R15349  10K  RESISTOR_0201  [0201]
R15350  10K  RESISTOR_0201  [0201]
R15351  10K  RESISTOR_0201  [0201]
R15352  10K  RESISTOR_0201  [0201]
R15353  10K  RESISTOR_0201  [0201]
R15354  10K  RESISTOR_0201  [0201]
R15355  10K  RESISTOR_0201  [0201]
R15356  10K  RESISTOR_0201  [0201]
R15357  10K  RESISTOR_0201  [0201]
R15358  10K  RESISTOR_0201  [0201]
R15359  10K  RESISTOR_0201  [0201]
R15360  10K  RESISTOR_0201  [0201]
R15361  10K  RESISTOR_0201  [0201]
R15362  10K  RESISTOR_0201  [0201]
R15363  10K  RESISTOR_0201  [0201]
R15364  10K  RESISTOR_0201  [0201]
R15365  10K  RESISTOR_0201  [0201]
R15366  10K  RESISTOR_0201  [0201]
R15367  10K  RESISTOR_0201  [0201]
R15368  10K  RESISTOR_0201  [0201]
R15369  10K  RESISTOR_0201  [0201]
R15370  10K  RESISTOR_0201  [0201]
R15371  10K  RESISTOR_0201  [0201]
R15372  10K  RESISTOR_0201  [0201]
R15373  10K  RESISTOR_0201  [0201]
R15374  10K  RESISTOR_0201  [0201]
R15375  10K  RESISTOR_0201  [0201]
R15376  10K  RESISTOR_0201  [0201]
R15377  10K  RESISTOR_0201  [0201]
R15378  10K  RESISTOR_0201  [0201]
R15379  10K  RESISTOR_0201  [0201]
R15380  10K  RESISTOR_0201  [0201]
R15381  10K  RESISTOR_0201  [0201]
R15382  10K  RESISTOR_0201  [0201]
R15383  10K  RESISTOR_0201  [0201]
R15384  10K  RESISTOR_0201  [0201]
R15385  10K  RESISTOR_0201  [0201]
R15386  10K  RESISTOR_0201  [0201]
R15387  10K  RESISTOR_0201  [0201]
R15388  10K  RESISTOR_0201  [0201]
R15389  10K  RESISTOR_0201  [0201]
R15390  10K  RESISTOR_0201  [0201]
R15391  10K  RESISTOR_0201  [0201]
R15392  10K  RESISTOR_0201  [0201]
R15393  10K  RESISTOR_0201  [0201]
R15394  10K  RESISTOR_0201  [0201]
R15395  10K  RESISTOR_0201  [0201]
R15396  10K  RESISTOR_0201  [0201]
R15397  10K  RESISTOR_0201  [0201]
R15398  10K  RESISTOR_0201  [0201]
R15399  10K  RESISTOR_0201  [0201]
R15400  10K  RESISTOR_0201  [0201]
R15401  10K  RESISTOR_0201  [0201]
R15402  10K  RESISTOR_0201  [0201]
R15403  10K  RESISTOR_0201  [0201]
R15404  10K  RESISTOR_0201  [0201]
R15405  10K  RESISTOR_0201  [0201]
R15406  10K  RESISTOR_0201  [0201]
R15407  10K  RESISTOR_0201  [0201]
R15408  10K  RESISTOR_0201  [0201]
R15409  10K  RESISTOR_0201  [0201]
R15410  10K  RESISTOR_0201  [0201]
R15411  10K  RESISTOR_0201  [0201]
R15412  10K  RESISTOR_0201  [0201]
R15413  10K  RESISTOR_0201  [0201]
R15414  10K  RESISTOR_0201  [0201]
R15415  10K  RESISTOR_0201  [0201]
R15416  10K  RESISTOR_0201  [0201]
R15417  10K  RESISTOR_0201  [0201]
R15418  10K  RESISTOR_0201  [0201]
R15419  10K  RESISTOR_0201  [0201]
R15420  10K  RESISTOR_0201  [0201]
R15421  10K  RESISTOR_0201  [0201]
R15422  10K  RESISTOR_0201  [0201]
R15423  10K  RESISTOR_0201  [0201]
R15424  10K  RESISTOR_0201  [0201]
R15425  10K  RESISTOR_0201  [0201]
R15426  10K  RESISTOR_0201  [0201]
R15427  10K  RESISTOR_0201  [0201]
R15428  10K  RESISTOR_0201  [0201]
R15429  10K  RESISTOR_0201  [0201]
R15430  10K  RESISTOR_0201  [0201]
R15431  10K  RESISTOR_0201  [0201]
R15432  10K  RESISTOR_0201  [0201]
R15433  10K  RESISTOR_0201  [0201]
R15434  10K  RESISTOR_0201  [0201]
R15435  10K  RESISTOR_0201  [0201]
R15436  10K  RESISTOR_0201  [0201]
R15437  10K  RESISTOR_0201  [0201]
R15438  10K  RESISTOR_0201  [0201]
R15439  10K  RESISTOR_0201  [0201]
R15440  10K  RESISTOR_0201  [0201]
R15441  10K  RESISTOR_0201  [0201]
R15442  10K  RESISTOR_0201  [0201]
R15443  10K  RESISTOR_0201  [0201]
R15444  10K  RESISTOR_0201  [0201]
R15445  10K  RESISTOR_0201  [0201]
R15446  10K  RESISTOR_0201  [0201]
R15447  10K  RESISTOR_0201  [0201]
R15448  10K  RESISTOR_0201  [0201]
R15449  10K  RESISTOR_0201  [0201]
R15450  10K  RESISTOR_0201  [0201]
R15451  10K  RESISTOR_0201  [0201]
R15452  10K  RESISTOR_0201  [0201]
R15453  10K  RESISTOR_0201  [0201]
R15454  10K  RESISTOR_0201  [0201]
R15455  10K  RESISTOR_0201  [0201]
R15456  10K  RESISTOR_0201  [0201]
R15457  10K  RESISTOR_0201  [0201]
R15458  10K  RESISTOR_0201  [0201]
R15459  10K  RESISTOR_0201  [0201]
R15460  10K  RESISTOR_0201  [0201]
R15461  10K  RESISTOR_0201  [0201]
R15462  10K  RESISTOR_0201  [0201]
R15463  10K  RESISTOR_0201  [0201]
R15464  10K  RESISTOR_0201  [0201]
R15465  10K  RESISTOR_0201  [0201]
R15466  10K  RESISTOR_0201  [0201]
R15467  10K  RESISTOR_0201  [0201]
R15468  10K  RESISTOR_0201  [0201]
R15469  10K  RESISTOR_0201  [0201]
R15470  10K  RESISTOR_0201  [0201]
R15471  10K  RESISTOR_0201  [0201]
R15472  10K  RESISTOR_0201  [0201]
R15473  10K  RESISTOR_0201  [0201]
R15474  10K  RESISTOR_0201  [0201]
R15475  10K  RESISTOR_0201  [0201]
R15476  10K  RESISTOR_0201  [0201]
R15477  10K  RESISTOR_0201  [0201]
R15478  10K  RESISTOR_0201  [0201]
R15479  10K  RESISTOR_0201  [0201]
R15480  10K  RESISTOR_0201  [0201]
R15481  10K  RESISTOR_0201  [0201]
R15482  10K  RESISTOR_0201  [0201]
R15483  10K  RESISTOR_0201  [0201]
R15484  10K  RESISTOR_0201  [0201]
R15485  10K  RESISTOR_0201  [0201]
R15486  10K  RESISTOR_0201  [0201]
R15487  10K  RESISTOR_0201  [0201]
R15488  10K  RESISTOR_0201  [0201]
R15489  10K  RESISTOR_0201  [0201]
R15490  10K  RESISTOR_0201  [0201]
R15491  10K  RESISTOR_0201  [0201]
R15492  10K  RESISTOR_0201  [0201]
R15493  10K  RESISTOR_0201  [0201]
R15494  10K  RESISTOR_0201  [0201]
R15495  10K  RESISTOR_0201  [0201]
R15496  10K  RESISTOR_0201  [0201]
R15497  10K  RESISTOR_0201  [0201]
R15498  10K  RESISTOR_0201  [0201]
R15499  10K  RESISTOR_0201  [0201]
R15500  10K  RESISTOR_0201  [0201]
R15501  10K  RESISTOR_0201  [0201]
R15502  10K  RESISTOR_0201  [0201]
R15503  10K  RESISTOR_0201  [0201]
R15504  10K  RESISTOR_0201  [0201]
R15505  10K  RESISTOR_0201  [0201]
R15506  10K  RESISTOR_0201  [0201]
R15507  10K  RESISTOR_0201  [0201]
R15508  10K  RESISTOR_0201  [0201]
R15509  10K  RESISTOR_0201  [0201]
R15510  10K  RESISTOR_0201  [0201]
R15511  10K  RESISTOR_0201  [0201]
R15512  10K  RESISTOR_0201  [0201]
R15513  10K  RESISTOR_0201  [0201]
R15514  10K  RESISTOR_0201  [0201]
R15515  10K  RESISTOR_0201  [0201]
R15516  10K  RESISTOR_0201  [0201]
R15517  10K  RESISTOR_0201  [0201]
R15518  10K  RESISTOR_0201  [0201]
R15519  10K  RESISTOR_0201  [0201]
R15520  10K  RESISTOR_0201  [0201]
R15521  10K  RESISTOR_0201  [0201]
R15522  10K  RESISTOR_0201  [0201]
R15523  10K  RESISTOR_0201  [0201]
R15524  10K  RESISTOR_0201  [0201]
R15525  10K  RESISTOR_0201  [0201]
R15526  10K  RESISTOR_0201  [0201]
R15527  10K  RESISTOR_0201  [0201]
R15528  10K  RESISTOR_0201  [0201]
R15529  10K  RESISTOR_0201  [0201]
R15530  10K  RESISTOR_0201  [0201]
R15531  10K  RESISTOR_0201  [0201]
R15532  10K  RESISTOR_0201  [0201]
R15533  10K  RESISTOR_0201  [0201]
R15534  10K  RESISTOR_0201  [0201]
R15535  10K  RESISTOR_0201  [0201]
R15536  10K  RESISTOR_0201  [0201]
R15537  10K  RESISTOR_0201  [0201]
R15538  10K  RESISTOR_0201  [0201]
R15539  10K  RESISTOR_0201  [0201]
R15540  10K  RESISTOR_0201  [0201]
R15541  10K  RESISTOR_0201  [0201]
R15542  10K  RESISTOR_0201  [0201]
R15543  10K  RESISTOR_0201  [0201]
R15544  10K  RESISTOR_0201  [0201]
R15545  10K  RESISTOR_0201  [0201]
R15546  10K  RESISTOR_0201  [0201]
R15547  10K  RESISTOR_0201  [0201]
R15548  10K  RESISTOR_0201  [0201]
R15549  10K  RESISTOR_0201  [0201]
R15550  10K  RESISTOR_0201  [0201]
R15551  10K  RESISTOR_0201  [0201]
R15552  10K  RESISTOR_0201  [0201]
R15553  10K  RESISTOR_0201  [0201]
R15554  10K  RESISTOR_0201  [0201]
R15555  10K  RESISTOR_0201  [0201]
R15556  10K  RESISTOR_0201  [0201]
R15557  10K  RESISTOR_0201  [0201]
R15558  10K  RESISTOR_0201  [0201]
R15559  10K  RESISTOR_0201  [0201]
R15560  10K  RESISTOR_0201  [0201]
R15561  10K  RESISTOR_0201  [0201]
R15562  10K  RESISTOR_0201  [0201]
R15563  10K  RESISTOR_0201  [0201]
R15564  10K  RESISTOR_0201  [0201]
R15565  10K  RESISTOR_0201  [0201]
R15566  10K  RESISTOR_0201  [0201]
R15567  10K  RESISTOR_0201  [0201]
R15568  10K  RESISTOR_0201  [0201]
R15569  10K  RESISTOR_0201  [0201]
R15570  10K  RESISTOR_0201  [0201]
R15571  10K  RESISTOR_0201  [0201]
R15572  10K  RESISTOR_0201  [0201]
R15573  10K  RESISTOR_0201  [0201]
R15574  10K  RESISTOR_0201  [0201]
R15575  10K  RESISTOR_0201  [0201]
R15576  10K  RESISTOR_0201  [0201]
R15577  10K  RESISTOR_0201  [0201]
R15578  10K  RESISTOR_0201  [0201]
R15579  10K  RESISTOR_0201  [0201]
R15580  10K  RESISTOR_0201  [0201]
R15581  10K  RESISTOR_0201  [0201]
R15582  10K  RESISTOR_0201  [0201]
R15583  10K  RESISTOR_0201  [0201]
R15584  10K  RESISTOR_0201  [0201]
R15585  10K  RESISTOR_0201  [0201]
R15586  10K  RESISTOR_0201  [0201]
R15587  10K  RESISTOR_0201  [0201]
R15588  10K  RESISTOR_0201  [0201]
R15589  10K  RESISTOR_0201  [0201]
R15590  10K  RESISTOR_0201  [0201]
R15591  10K  RESISTOR_0201  [0201]
R15592  10K  RESISTOR_0201  [0201]
R15593  10K  RESISTOR_0201  [0201]
R15594  10K  RESISTOR_0201  [0201]
R15595  10K  RESISTOR_0201  [0201]
R15596  10K  RESISTOR_0201  [0201]
R15597  10K  RESISTOR_0201  [0201]
R15598  10K  RESISTOR_0201  [0201]
R15599  10K  RESISTOR_0201  [0201]
R15600  10K  RESISTOR_0201  [0201]
R15601  10K  RESISTOR_0201  [0201]
R15602  10K  RESISTOR_0201  [0201]
R15603  10K  RESISTOR_0201  [0201]
R15604  10K  RESISTOR_0201  [0201]
R15605  10K  RESISTOR_0201  [0201]
R15606  10K  RESISTOR_0201  [0201]
R15607  10K  RESISTOR_0201  [0201]
R15608  10K  RESISTOR_0201  [0201]
R15609  10K  RESISTOR_0201  [0201]
R15610  10K  RESISTOR_0201  [0201]
R15611  10K  RESISTOR_0201  [0201]
R15612  10K  RESISTOR_0201  [0201]
R15613  10K  RESISTOR_0201  [0201]
R15614  10K  RESISTOR_0201  [0201]
R15615  10K  RESISTOR_0201  [0201]
R15616  10K  RESISTOR_0201  [0201]
R15617  10K  RESISTOR_0201  [0201]
R15618  10K  RESISTOR_0201  [0201]
R15619  10K  RESISTOR_0201  [0201]
R15620  10K  RESISTOR_0201  [0201]
R15621  10K  RESISTOR_0201  [0201]
R15622  10K  RESISTOR_0201  [0201]
R15623  10K  RESISTOR_0201  [0201]
R15624  10K  RESISTOR_0201  [0201]
R15625  10K  RESISTOR_0201  [0201]
R15626  10K  RESISTOR_0201  [0201]
R15627  10K  RESISTOR_0201  [0201]
R15628  10K  RESISTOR_0201  [0201]
R15629  10K  RESISTOR_0201  [0201]
R15630  10K  RESISTOR_0201  [0201]
R15631  10K  RESISTOR_0201  [0201]
R15632  10K  RESISTOR_0201  [0201]
R15633  10K  RESISTOR_0201  [0201]
R15634  10K  RESISTOR_0201  [0201]
R15635  10K  RESISTOR_0201  [0201]
R15636  10K  RESISTOR_0201  [0201]
R15637  10K  RESISTOR_0201  [0201]
R15638  10K  RESISTOR_0201  [0201]
R15639  10K  RESISTOR_0201  [0201]
R15640  10K  RESISTOR_0201  [0201]
R15641  10K  RESISTOR_0201  [0201]
R15642  10K  RESISTOR_0201  [0201]
R15643  10K  RESISTOR_0201  [0201]
R15644  10K  RESISTOR_0201  [0201]
R15645  10K  RESISTOR_0201  [0201]
R15646  10K  RESISTOR_0201  [0201]
R15647  10K  RESISTOR_0201  [0201]
R15648  10K  RESISTOR_0201  [0201]
R15649  10K  RESISTOR_0201  [0201]
R15650  10K  RESISTOR_0201  [0201]
R15651  10K  RESISTOR_0201  [0201]
R15652  10K  RESISTOR_0201  [0201]
R15653  10K  RESISTOR_0201  [0201]
R15654  10K  RESISTOR_0201  [0201]
R15655  10K  RESISTOR_0201  [0201]
R15656  10K  RESISTOR_0201  [0201]
R15657  10K  RESISTOR_0201  [0201]
R15658  10K  RESISTOR_0201  [0201]
R15659  10K  RESISTOR_0201  [0201]
R15660  10K  RESISTOR_0201  [0201]
R15661  10K  RESISTOR_0201  [0201]
R15662  10K  RESISTOR_0201  [0201]
R15663  10K  RESISTOR_0201  [0201]
R15664  10K  RESISTOR_0201  [0201]
R15665  10K  RESISTOR_0201  [0201]
R15666  10K  RESISTOR_0201  [0201]
R15667  10K  RESISTOR_0201  [0201]
R15668  10K  RESISTOR_0201  [0201]
R15669  10K  RESISTOR_0201  [0201]
R15670  10K  RESISTOR_0201  [0201]
R15671  10K  RESISTOR_0201  [0201]
R15672  10K  RESISTOR_0201  [0201]
R15673  10K  RESISTOR_0201  [0201]
R15674  10K  RESISTOR_0201  [0201]
R15675  10K  RESISTOR_0201  [0201]
R15676  10K  RESISTOR_0201  [0201]
R15677  10K  RESISTOR_0201  [0201]
R15678  10K  RESISTOR_0201  [0201]
R15679  10K  RESISTOR_0201  [0201]
R15680  10K  RESISTOR_0201  [0201]
R15681  10K  RESISTOR_0201  [0201]
R15682  10K  RESISTOR_0201  [0201]
R15683  10K  RESISTOR_0201  [0201]
R15684  10K  RESISTOR_0201  [0201]
R15685  10K  RESISTOR_0201  [0201]
R15686  10K  RESISTOR_0201  [0201]
R15687  10K  RESISTOR_0201  [0201]
R15688  10K  RESISTOR_0201  [0201]
R15689  10K  RESISTOR_0201  [0201]
R15690  10K  RESISTOR_0201  [0201]
R15691  10K  RESISTOR_0201  [0201]
R15692  10K  RESISTOR_0201  [0201]
R15693  10K  RESISTOR_0201  [0201]
R15694  10K  RESISTOR_0201  [0201]
R15695  10K  RESISTOR_0201  [0201]
R15696  10K  RESISTOR_0201  [0201]
R15697  10K  RESISTOR_0201  [0201]
R15698  10K  RESISTOR_0201  [0201]
R15699  10K  RESISTOR_0201  [0201]
R15700  10K  RESISTOR_0201  [0201]
R15701  10K  RESISTOR_0201  [0201]
R15702  10K  RESISTOR_0201  [0201]
R15703  10K  RESISTOR_0201  [0201]
R15704  10K  RESISTOR_0201  [0201]
R15705  10K  RESISTOR_0201  [0201]
R15706  10K  RESISTOR_0201  [0201]
R15707  10K  RESISTOR_0201  [0201]
R15708  10K  RESISTOR_0201  [0201]
R15709  10K  RESISTOR_0201  [0201]
R15710  10K  RESISTOR_0201  [0201]
R15711  10K  RESISTOR_0201  [0201]
R15712  10K  RESISTOR_0201  [0201]
R15713  10K  RESISTOR_0201  [0201]
R15714  10K  RESISTOR_0201  [0201]
R15715  10K  RESISTOR_0201  [0201]
R15716  10K  RESISTOR_0201  [0201]
R15717  10K  RESISTOR_0201  [0201]
R15718  10K  RESISTOR_0201  [0201]
R15719  10K  RESISTOR_0201  [0201]
R15720  10K  RESISTOR_0201  [0201]
R15721  10K  RESISTOR_0201  [0201]
R15722  10K  RESISTOR_0201  [0201]
R15723  10K  RESISTOR_0201  [0201]
R15724  10K  RESISTOR_0201  [0201]
R15725  10K  RESISTOR_0201  [0201]
R15726  10K  RESISTOR_0201  [0201]
R15727  10K  RESISTOR_0201  [0201]
R15728  10K  RESISTOR_0201  [0201]
R15729  10K  RESISTOR_0201  [0201]
R15730  10K  RESISTOR_0201  [0201]
R15731  10K  RESISTOR_0201  [0201]
R15732  10K  RESISTOR_0201  [0201]
R15733  10K  RESISTOR_0201  [0201]
R15734  10K  RESISTOR_0201  [0201]
R15735  10K  RESISTOR_0201  [0201]
R15736  10K  RESISTOR_0201  [0201]
R15737  10K  RESISTOR_0201  [0201]
R15738  10K  RESISTOR_0201  [0201]
R15739  10K  RESISTOR_0201  [0201]
R15740  10K  RESISTOR_0201  [0201]
R15741  10K  RESISTOR_0201  [0201]
R15742  10K  RESISTOR_0201  [0201]
R15743  10K  RESISTOR_0201  [0201]
R15744  10K  RESISTOR_0201  [0201]
R15745  10K  RESISTOR_0201  [0201]
R15746  10K  RESISTOR_0201  [0201]
R15747  10K  RESISTOR_0201  [0201]
R15748  10K  RESISTOR_0201  [0201]
R15749  10K  RESISTOR_0201  [0201]
R15750  10K  RESISTOR_0201  [0201]
R15751  10K  RESISTOR_0201  [0201]
R15752  10K  RESISTOR_0201  [0201]
R15753  10K  RESISTOR_0201  [0201]
R15754  10K  RESISTOR_0201  [0201]
R15755  10K  RESISTOR_0201  [0201]
R15756  10K  RESISTOR_0201  [0201]
R15757  10K  RESISTOR_0201  [0201]
R15758  10K  RESISTOR_0201  [0201]
R15759  10K  RESISTOR_0201  [0201]
R15760  10K  RESISTOR_0201  [0201]
R15761  10K  RESISTOR_0201  [0201]
R15762  10K  RESISTOR_0201  [0201]
R15763  10K  RESISTOR_0201  [0201]
R15764  10K  RESISTOR_0201  [0201]
R15765  10K  RESISTOR_0201  [0201]
R15766  10K  RESISTOR_0201  [0201]
R15767  10K  RESISTOR_0201  [0201]
R15768  10K  RESISTOR_0201  [0201]
R15769  10K  RESISTOR_0201  [0201]
R15770  10K  RESISTOR_0201  [0201]
R15771  10K  RESISTOR_0201  [0201]
R15772  10K  RESISTOR_0201  [0201]
R15773  10K  RESISTOR_0201  [0201]
R15774  10K  RESISTOR_0201  [0201]
R15775  10K  RESISTOR_0201  [0201]
R15776  10K  RESISTOR_0201  [0201]
R15777  10K  RESISTOR_0201  [0201]
R15778  10K  RESISTOR_0201  [0201]
R15779  10K  RESISTOR_0201  [0201]
R15780  10K  RESISTOR_0201  [0201]
R15781  10K  RESISTOR_0201  [0201]
R15782  10K  RESISTOR_0201  [0201]
R15783  10K  RESISTOR_0201  [0201]
R15784  10K  RESISTOR_0201  [0201]
R15785  10K  RESISTOR_0201  [0201]
R15786  10K  RESISTOR_0201  [0201]
R15787  10K  RESISTOR_0201  [0201]
R15788  10K  RESISTOR_0201  [0201]
R15789  10K  RESISTOR_0201  [0201]
R15790  10K  RESISTOR_0201  [0201]
R15791  10K  RESISTOR_0201  [0201]
R15792  10K  RESISTOR_0201  [0201]
R15793  10K  RESISTOR_0201  [0201]
R15794  10K  RESISTOR_0201  [0201]
R15795  10K  RESISTOR_0201  [0201]
R15796  10K  RESISTOR_0201  [0201]
R15797  10K  RESISTOR_0201  [0201]
R15798  10K  RESISTOR_0201  [0201]
R15799  10K  RESISTOR_0201  [0201]
R15800  10K  RESISTOR_0201  [0201]
R15801  10K  RESISTOR_0201  [0201]
R15802  10K  RESISTOR_0201  [0201]
R15803  10K  RESISTOR_0201  [0201]
R15804  10K  RESISTOR_0201  [0201]
R15805  10K  RESISTOR_0201  [0201]
R15806  10K  RESISTOR_0201  [0201]
R15807  10K  RESISTOR_0201  [0201]
R15808  10K  RESISTOR_0201  [0201]
R15809  10K  RESISTOR_0201  [0201]
R15810  10K  RESISTOR_0201  [0201]
R15811  10K  RESISTOR_0201  [0201]
R15812  10K  RESISTOR_0201  [0201]
R15813  10K  RESISTOR_0201  [0201]
R15814  10K  RESISTOR_0201  [0201]
R15815  10K  RESISTOR_0201  [0201]
R15816  10K  RESISTOR_0201  [0201]
R15817  10K  RESISTOR_0201  [0201]
R15818  10K  RESISTOR_0201  [0201]
R15819  10K  RESISTOR_0201  [0201]
R15820  10K  RESISTOR_0201  [0201]
R15821  10K  RESISTOR_0201  [0201]
R15822  10K  RESISTOR_0201  [0201]
R15823  10K  RESISTOR_0201  [0201]
R15824  10K  RESISTOR_0201  [0201]
R15825  10K  RESISTOR_0201  [0201]
R15826  10K  RESISTOR_0201  [0201]
R15827  10K  RESISTOR_0201  [0201]
R15828  10K  RESISTOR_0201  [0201]
R15829  10K  RESISTOR_0201  [0201]
R15830  10K  RESISTOR_0201  [0201]
R15831  10K  RESISTOR_0201  [0201]
R15832  10K  RESISTOR_0201  [0201]
R15833  10K  RESISTOR_0201  [0201]
R15834  10K  RESISTOR_0201  [0201]
R15835  10K  RESISTOR_0201  [0201]
R15836  10K  RESISTOR_0201  [0201]
R15837  10K  RESISTOR_0201  [0201]
R15838  10K  RESISTOR_0201  [0201]
R15839  10K  RESISTOR_0201  [0201]
R15840  10K  RESISTOR_0201  [0201]
R15841  10K  RESISTOR_0201  [0201]
R15842  10K  RESISTOR_0201  [0201]
R15843  10K  RESISTOR_0201  [0201]
R15844  10K  RESISTOR_0201  [0201]
R15845  10K  RESISTOR_0201  [0201]
R15846  10K  RESISTOR_0201  [0201]
R15847  10K  RESISTOR_0201  [0201]
R15848  10K  RESISTOR_0201  [0201]
R15849  10K  RESISTOR_0201  [0201]
R15850  10K  RESISTOR_0201  [0201]
R15851  10K  RESISTOR_0201  [0201]
R15852  10K  RESISTOR_0201  [0201]
R15853  10K  RESISTOR_0201  [0201]
R15854  10K  RESISTOR_0201  [0201]
R15855  10K  RESISTOR_0201  [0201]
R15856  10K  RESISTOR_0201  [0201]
R15857  10K  RESISTOR_0201  [0201]
R15858  10K  RESISTOR_0201  [0201]
R15859  10K  RESISTOR_0201  [0201]
R15860  10K  RESISTOR_0201  [0201]
R15861  10K  RESISTOR_0201  [0201]
R15862  10K  RESISTOR_0201  [0201]
R15863  10K  RESISTOR_0201  [0201]
R15864  10K  RESISTOR_0201  [0201]
R15865  10K  RESISTOR_0201  [0201]
R15866  10K  RESISTOR_0201  [0201]
R15867  10K  RESISTOR_0201  [0201]
R15868  10K  RESISTOR_0201  [0201]
R15869  10K  RESISTOR_0201  [0201]
R15870  10K  RESISTOR_0201  [0201]
R15871  10K  RESISTOR_0201  [0201]
R15872  10K  RESISTOR_0201  [0201]
R15873  10K  RESISTOR_0201  [0201]
R15874  10K  RESISTOR_0201  [0201]
R15875  10K  RESISTOR_0201  [0201]
R15876  10K  RESISTOR_0201  [0201]
R15877  10K  RESISTOR_0201  [0201]
R15878  10K  RESISTOR_0201  [0201]
R15879  10K  RESISTOR_0201  [0201]
R15880  10K  RESISTOR_0201  [0201]
R15881  10K  RESISTOR_0201  [0201]
R15882  10K  RESISTOR_0201  [0201]
R15883  10K  RESISTOR_0201  [0201]
R15884  10K  RESISTOR_0201  [0201]
R15885  10K  RESISTOR_0201  [0201]
R15886  10K  RESISTOR_0201  [0201]
R15887  10K  RESISTOR_0201  [0201]
R15888  10K  RESISTOR_0201  [0201]
R15889  10K  RESISTOR_0201  [0201]
R15890  10K  RESISTOR_0201  [0201]
R15891  10K  RESISTOR_0201  [0201]
R15892  10K  RESISTOR_0201  [0201]
R15893  10K  RESISTOR_0201  [0201]
R15894  10K  RESISTOR_0201  [0201]
R15895  10K  RESISTOR_0201  [0201]
R15896  10K  RESISTOR_0201  [0201]
R15897  10K  RESISTOR_0201  [0201]
R15898  10K  RESISTOR_0201  [0201]
R15899  10K  RESISTOR_0201  [0201]
R15900  10K  RESISTOR_0201  [0201]
R15901  10K  RESISTOR_0201  [0201]
R15902  10K  RESISTOR_0201  [0201]
R15903  10K  RESISTOR_0201  [0201]
R15904  10K  RESISTOR_0201  [0201]
R15905  10K  RESISTOR_0201  [0201]
R15906  10K  RESISTOR_0201  [0201]
R15907  10K  RESISTOR_0201  [0201]
R15908  10K  RESISTOR_0201  [0201]
R15909  10K  RESISTOR_0201  [0201]
R15910  10K  RESISTOR_0201  [0201]
R15911  10K  RESISTOR_0201  [0201]
R15912  10K  RESISTOR_0201  [0201]
R15913  10K  RESISTOR_0201  [0201]
R15914  10K  RESISTOR_0201  [0201]
R15915  10K  RESISTOR_0201  [0201]
R15916  10K  RESISTOR_0201  [0201]
R15917  10K  RESISTOR_0201  [0201]